# Altium schematic sheet PRR132D02.SchDoc: Плата PRR132D (continued)
## Parts (continued)
C99  C0402-16В-0,1мкФ-10%-X7R (CCTC, TCC0402X7R104K160AT)  [C0402]  (value not drawn)
C100  не устанавливать  [TAJ-A]  (value not drawn)
C101  не устанавливать  [C1210]  (value not drawn)
C102  не устанавливать  [CC1206-KL]  (value not drawn)
C103  не устанавливать  [CC1206-KL]  (value not drawn)
C104  C0603-10В-10мкф-10%-X5R (Samsung, CL10A106KP8NNNC)  [CC0603-KL]  (value not drawn)
C105  C0402-16В-0,1мкФ-10%-X7R (CCTC, TCC0402X7R104K160AT)  [C0402]  (value not drawn)
C106  C0402-16В-0,1мкФ-10%-X7R (CCTC, TCC0402X7R104K160AT)  [C0402]  (value not drawn)
C107  C0402-50В-100пФ-5%-NPO (Walsin, 0402N101J500CT)  [C0402]  (value not drawn)
C108  C0402-50В-100пФ-5%-NPO (Walsin, 0402N101J500CT)  [C0402]  (value not drawn)
C109  C0402-10В-1мкФ-10%-X5R (CCTC, TCC0402X5R105K100AT)  [C0402]  (value not drawn)
C110  C0402-10В-1мкФ-10%-X5R (CCTC, TCC0402X5R105K100AT)  [C0402]  (value not drawn)
C111  C0402-50В-0,01мкФ-10%-X7R (Samsung, CL05B103KB5NNNC)  [C0402]  (value not drawn)
CP1  *  [COMMON_POINT _1.0]  (value not drawn)  (net tie, no BOM)
DA1  TLV1117LV33DCYR (TI, SOT-223)  [SOT-223]  (value not drawn)
DA2  TLV1117LV33DCYR (TI, SOT-223)  [SOT-223]  (value not drawn)
DA4  TPS73125DBVR (SOT-23-5, TI)  [SOT23-5]  (value not drawn)
DA5  TL431BQDBZR (TI, SOT23-3)  [SOT-23A]  (value not drawn)
DA6  MCP1700T-3302E/TT (Mic,SOT23-3)  [SOT-23A]  (value not drawn)
DD7  SN74LVC1G17DBV (Ti,SOT23-5)  [SOT23-5]  (value not drawn)
DD8  MC74ACT125DTR2 (OnSemi, TSSOP-14)  [TSOP-14(0.65)]  (value not drawn)
DD9  MC74ACT125DTR2 (OnSemi, TSSOP-14)  [TSOP-14(0.65)]  (value not drawn)
DD10  RTL8201FRI-VD-CG  [QFN-24(0.5)-PAD]
DD11  NL27WZ17DFT2G (ONSemi, SC70-6)  [SOT65P210-6N]  (value not drawn)
DD12  NL27WZ17DFT2G (ONSemi, SC70-6)  [SOT65P210-6N]  (value not drawn)
DD13  STM32F407VET6 (STM, LQFP-100)  [TSQFP50P1600X1600X160-100N]  (value not drawn)
DD14  SN74LVC1G80DBVR (TI, SOT23-5)  [SOT23-5]  (value not drawn)
DD15  NL27WZ17DFT2G (ONSemi, SC70-6)  [SOT65P210-6N]  (value not drawn)
DD17  MB85RS16NPNF (Fujitsu, SOP-8)  [SOIC127P600X150-8N]  (value not drawn)
DD18  MX25L3233FM2I-08G (Macronix, SO-8)  [SOP127P790X216-8N]  (value not drawn)
DD20  SN74AHC1G14DCKR (TI, SC-70-5)  [SC70-5]  (value not drawn)
DD21  SN74AHC1G08DCKR (TI, SC-70-5)  [SC70_5L]  (value not drawn)
DD22  74AHCT1G125SE (Diodes, SOT-353)  [SOT65P210-5N]  (value not drawn)
DD23  74AHCT1G125SE (Diodes, SOT-353)  [SOT65P210-5N]  (value not drawn)
GQ1  DSK321STDAKAV-32,768kHz +/-5ppm (KDS, 3.2x2.5x0.9mm)  [DSK321STD]  (value not drawn)
GQ2  не устанавливать  [XTALCC320X150X90-4N]  (value not drawn)
HL35  FYLS-0603PGC (Foryard)  [KPT-1608]  (value not drawn)
HL36  FYLS-0603PGC (Foryard)  [KPT-1608]  (value not drawn)
HL37  FYLS-0603PGC (Foryard)  [KPT-1608]  (value not drawn)
HL38  FYLS-0603PGC (Foryard)  [KPT-1608]  (value not drawn)
HL39  KPT-1608SRC  [KPT-1608]  (value not drawn)
HL40  KPT-1608SRC  [KPT-1608]  (value not drawn)
HL41  не устанавливать  [KPT-1608]  (value not drawn)
HL42  не устанавливать  [KPT-1608]  (value not drawn)
L2  FB0805-5А-120 Ом (100МГц)-25%-0,02 Ом (INPAQ, MHC2012S121UBP)  [L0805]  (value not drawn)
L3  FB0805-5А-120 Ом (100МГц)-25%-0,02 Ом (INPAQ, MHC2012S121UBP)  [L0805]  (value not drawn)
L4  FB0805-5А-120 Ом (100МГц)-25%-0,02 Ом (INPAQ, MHC2012S121UBP)  [L0805]  (value not drawn)
L5  FB0805-5А-120 Ом (100МГц)-25%-0,02 Ом (INPAQ, MHC2012S121UBP)  [L0805]  (value not drawn)
L6  FB0805-5А-120 Ом (100МГц)-25%-0,02 Ом (INPAQ, MHC2012S121UBP)  [L0805]  (value not drawn)
L8  FB0805-5А-120 Ом (100МГц)-25%-0,02 Ом (INPAQ, MHC2012S121UBP)  [L0805]  (value not drawn)
L9  FB0805-5А-120 Ом (100МГц)-25%-0,02 Ом (INPAQ, MHC2012S121UBP)  [L0805]  (value not drawn)
MH1  *  [MOTB14]  (value not drawn)  (no BOM)
MH2  *  [MOTB14]  (value not drawn)  (no BOM)
MH3  *  [MOTB14]  (value not drawn)  (no BOM)
MH4  *  [MOTB14]  (value not drawn)  (no BOM)
MH5  *  [MOTB14]  (value not drawn)  (no BOM)
MH6  *  [MOTB14]  (value not drawn)  (no BOM)
R3  RC02-47кОм 1%  [R0402]  (value not drawn)
R4  RC02-47кОм 1%  [R0402]  (value not drawn)
R5  RC02-47кОм 1%  [R0402]  (value not drawn)
R6  RC02-47кОм 1%  [R0402]  (value not drawn)
R7  RC02-1,5кОм 5%  [R0402]  (value not drawn)
R8  RC02-1,0кОм 1%  [R0402]  (value not drawn)
R59  RC02-47кОм 1%  [R0402]  (value not drawn)
R60  Не устанавливать  [R0402]  (value not drawn)
R61  RC02-4,7кОм 5%  [R0402]  (value not drawn)
R62  RC02-10кОм 1%  [R0402]  (value not drawn)
R63  RC02-100 Ом 1% (Viking, CR-02FL6--100R)  [R0402]  (value not drawn)
R64  RC02-100 Ом 1% (Viking, CR-02FL6--100R)  [R0402]  (value not drawn)
R65  RC02-22 Ом-1%  [R0402]  (value not drawn)
R66  Не устанавливать  [R0402]  (value not drawn)
R67  Не устанавливать  [R0402]  (value not drawn)
R68  Не устанавливать  [R0402]  (value not drawn)
R69  RC02-22 Ом-1%  [R0402]  (value not drawn)
R70  RC02-22 Ом-1%  [R0402]  (value not drawn)
R71  RC02-22 Ом-1%  [R0402]  (value not drawn)
R72  RC02-22 Ом-1%  [R0402]  (value not drawn)
R73  Не устанавливать  [R0402]  (value not drawn)
R74  Не устанавливать  [R0402]  (value not drawn)
R75  Не устанавливать  [R0402]  (value not drawn)
R76  Не устанавливать  [R0402]  (value not drawn)
R77  RC03-0,0 Ом 5%  [RC0603-KL]  (value not drawn)
R78  Не устанавливать  [RC0603-KL]  (value not drawn)
R79  RC02-10кОм 1%  [R0402]  (value not drawn)
R80  RC03-0,0 Ом 5%  [RC0603-KL]  (value not drawn)
R81  не устанавливать  [RC0603-KL]  (value not drawn)
R82  RC02-10кОм 1%  [R0402]  (value not drawn)
R83  RC03-0,0 Ом 5%  [RC0603-KL]  (value not drawn)
R84  не устанавливать  [RC0603-KL]  (value not drawn)
R85  RC02-4,7кОм 5%  [R0402]  (value not drawn)
R86  RC02-2,37кОм 1% (Walsin, WR04X2371FTL)  [R0402]  (value not drawn)
R87  RC02-4,7кОм 5%  [R0402]  (value not drawn)
R88  RC02-330 Ом 5% (Viking, CR-02JL6--330R)  [R0402]  (value not drawn)
R89  RC02-330 Ом 5% (Viking, CR-02JL6--330R)  [R0402]  (value not drawn)
R90  RC02-330 Ом 5% (Viking, CR-02JL6--330R)  [R0402]  (value not drawn)
R91  RC02-330 Ом 5% (Viking, CR-02JL6--330R)  [R0402]  (value not drawn)
R92  RC02-330 Ом 5% (Viking, CR-02JL6--330R)  [R0402]  (value not drawn)
R93  RC02-330 Ом 5% (Viking, CR-02JL6--330R)  [R0402]  (value not drawn)
R94  RC02-22 Ом-1%  [R0402]  (value not drawn)
R95  RC02-10кОм 1%  [R0402]  (value not drawn)
R96  RC03-0,0 Ом 5%  [RC0603-KL]  (value not drawn)
R97  RC03-20МОм 5%  [RC0603-KL]  (value not drawn)
R98  RC02-3,01кОм 1%  [R0402]  (value not drawn)
R99  RC02-22 Ом-1%  [R0402]  (value not drawn)
R100  RC02-22 Ом-1%  [R0402]  (value not drawn)
R101  RC02-10кОм 1%  [R0402]  (value not drawn)
R102  RC02-0,0 Ом 5%  [R0402]  (value not drawn)
R103  RC03-180 Ом 1%  [RC0603-KL]  (value not drawn)
R104  RC02-22 Ом-1%  [R0402]  (value not drawn)
R105  RC02-22 Ом-1%  [R0402]  (value not drawn)
R106  RC02-22 Ом-1%  [R0402]  (value not drawn)
R107  RC02-22 Ом-1%  [R0402]  (value not drawn)
R108  RC02-22 Ом-1%  [R0402]  (value not drawn)
R109  RC02-22 Ом-1%  [R0402]  (value not drawn)
R110  RC02-22 Ом-1%  [R0402]  (value not drawn)
R111  RC02-0,0 Ом 5%  [R0402]  (value not drawn)
R112  RC02-22 Ом-1%  [R0402]  (value not drawn)
R113  RC02-22 Ом-1%  [R0402]  (value not drawn)
R114  RC02-22 Ом-1%  [R0402]  (value not drawn)
R115  RC02-22 Ом-1%  [R0402]  (value not drawn)
R116  RC02-22 Ом-1%  [R0402]  (value not drawn)
R117  RC02-22 Ом-1%  [R0402]  (value not drawn)
R118  RC02-22 Ом-1%  [R0402]  (value not drawn)
R119  RC02-22 Ом-1%  [R0402]  (value not drawn)
R120  RC02-1,0кОм 1%  [R0402]  (value not drawn)
R121  Не устанавливать  [R0402]  (value not drawn)
R122  RC02-4,7кОм 5%  [R0402]  (value not drawn)
R123  Не устанавливать  [R0402]  (value not drawn)
R124  RC02-4,7кОм 5%  [R0402]  (value not drawn)
R125  RC02-4,7кОм 5%  [R0402]  (value not drawn)
R128  RC02-4,7кОм 5%  [R0402]  (value not drawn)
R129  RC03-2,49кОм 1% (Yageo, RC0603FR-072K49L)  [RC0603-KL]  (value not drawn)
R130  RC02-1,5кОм 5%  [R0402]  (value not drawn)
R131  RC02-10кОм 1%  [R0402]  (value not drawn)
R133  RC02-22 Ом-1%  [R0402]  (value not drawn)
R134  RC02-22 Ом-1%  [R0402]  (value not drawn)
R135  RC02-10кОм 1%  [R0402]  (value not drawn)
R137  RC02-1,5кОм 5%  [R0402]  (value not drawn)
R138  RC02-1,5кОм 5%  [R0402]  (value not drawn)
R139  RC02-49,9 Ом 1%  [R0402]  (value not drawn)
R140  RC02-49,9 Ом 1%  [R0402]  (value not drawn)
R141  RC02-49,9 Ом 1%  [R0402]  (value not drawn)
R142  RC02-49,9 Ом 1%  [R0402]  (value not drawn)
R143  RC02-1,0кОм 1%  [R0402]  (value not drawn)
R144  RC02-47кОм 1%  [R0402]  (value not drawn)
R147  RC02-4,7кОм 5%  [R0402]  (value not drawn)
R148  RC02-4,7кОм 5%  [R0402]  (value not drawn)
R149  RC02-470 Ом 1%  [R0402]  (value not drawn)
R150  RC02-470 Ом 1%  [R0402]  (value not drawn)
R152  RC02-3,01кОм 1%  [R0402]  (value not drawn)
R153  RC02-3,01кОм 1%  [R0402]  (value not drawn)
R154  RC02-3,01кОм 1%  [R0402]  (value not drawn)
R155  RC02-330 Ом 5% (Viking, CR-02JL6--330R)  [R0402]  (value not drawn)
R156  RC02-330 Ом 5% (Viking, CR-02JL6--330R)  [R0402]  (value not drawn)
R157  RC05-1,0МОм 5%  [RC0805-KL]  (value not drawn)
R158  RC02-1,5кОм 5%  [R0402]  (value not drawn)
R160  Не устанавливать  [R0402]  (value not drawn)
R161  Не устанавливать  [R0402]  (value not drawn)
R162  RC03-10МОм 5%  [RC0603-KL]  (value not drawn)
R163  RC03-20МОм 5%  [RC0603-KL]  (value not drawn)
R164  RC02-47кОм 1%  [R0402]  (value not drawn)
R165  RC02-47кОм 1%  [R0402]  (value not drawn)
R166  RC02-1,5кОм 5%  [R0402]  (value not drawn)
R167  RC02-0,0 Ом 5%  [R0402]  (value not drawn)
R168  RC02-0,0 Ом 5%  [R0402]  (value not drawn)
R169  RC02-22 Ом-1%  [R0402]  (value not drawn)
R170  RC02-22 Ом-1%  [R0402]  (value not drawn)
R173  RC03-0,0 Ом 5%  [RC0603-KL]  (value not drawn)
R174  Не устанавливать  [RC0603-KL]  (value not drawn)
SA1  DS1040-01RN (Connfly)  [SWD1-1]  (value not drawn)
SB1  C8310-AABBR000R (HSM)  [KAN0641-0431B]  (value not drawn)
T98  *  [TR15x25]  (value not drawn)  (no BOM)
VD6  MBR0520L (ONSemi, SOD-123)  [SOD123]  (value not drawn)
VD7  MBR0520L (ONSemi, SOD-123)  [SOD123]  (value not drawn)
VD8  MBR0520L (ONSemi, SOD-123)  [SOD123]  (value not drawn)
VD9  BZV55C5V1 (Phil,SOD80C)  [DL-35]  (value not drawn)
VD10  BZV55C5V1 (Phil,SOD80C)  [DL-35]  (value not drawn)
VD12  NUP4114HMR6T1G (OnSemi, SOT23-6)  [SOT23-6]  (value not drawn)
VD13  BAW156 (NXP, SOT-23)  [SOT-23A]  (value not drawn)
VD14  BAW156 (NXP, SOT-23)  [SOT-23A]  (value not drawn)
VT3  IRLML6401 (Infineon, SOT-23)  [SOT-23A]  (value not drawn)
VT4  BC817-40L (ONSemi, SOT-23)  [SOT-23A]  (value not drawn)
VT5  BC857B (NXP, SOT-23)  [SOT-23A]  (value not drawn)
X1  Battery holder DS1092-07-W8L (Connfly)  [CR2032_DIP_Batt]  (value not drawn)
XP1  BH2-08  [BH2S-08 (AMTEK)]  (value not drawn)  (parts A,B,C,D,E,F,G,H of 8)
XP2  PLS-1 (Connfly, DS1021-1*40SF11) 2 шт  [JUMP2]  (value not drawn)
XS2  PBD2-2-7SM (HSM, C6802-14BDGLYQR)  [PBD2-14SM]  (value not drawn)  (parts A,B,C,D,E,F,G,H,I,J,K,L,M,N of 14)
XS3  PBD2-2-13SM-G-PCG-4,6mm  [PBD2-26SM]  (value not drawn)  (parts A,B,C,D,E,F,G,H,I,J,K,L,M,N,O,P,Q,R,S,T,U,V,W,X,Y,Z of 26)
XS4  PBD2-2-13SM-G-PCG-4,6mm  [PBD2-26SM]  (value not drawn)  (parts A,B,C,D,E,F,G,H,I,J,K,L,M,N,O,P,Q,R,S,T,U,V,W,X,Y,Z of 26)
XS5  PBD2-2-4SM (HSM, C6802-08BDGLYQR)  [PBD2-8SM]  (value not drawn)
XS6  PBD2-2-4SM (HSM, C6802-08BDGLYQR)  [PBD2-8SM]  (value not drawn)
XS7  C8362-05BBSBR1R  (Hsuan Mao)  [Micro_USB_B_TH_V]  (value not drawn)
XS8  PBD2-2-7SM (HSM, C6802-14BDGLYQR)  [PBD2-14SM]  (value not drawn)  (parts A,B,C,D,E,F,G,H,I,J,K,L,M,N of 14)

## Nets
3.3_485: C110.2 DA6.2(Vout) MH5.1 XS5.3 XS6.2
3.3V: C23.1 C58.1 C76.2 DD15.5(VCC) HL36.A HL37.A L5.2 L6.1 MH3.1 R59.1 R62.2 R80.1 R83.1 R98.2 R122.1 R123.1 R124.1 R128.1 R130.1 R131.1 R147.2 R148.2 R149.1 R150.1 R160.1 R161.1 VT3.3(D) XS4.16
3.3V_ETH: C68.1 C71.2 C74.1 C80.1 C81.2 DD10.10(DVDDIO) L6.2 R139.2 R140.2 R141.2 R142.2 XS8.11 XS8.12
3.3V_SYS: BQ2.1(OE) C14.2 C34.2 C35.2 C38.2 C41.2 C44.2 C47.2 C49.2 C51.2 C53.2 C54.2 C63.2 C65.2 C66.2 DA2.2(OUT) DD13.11(VDD) DD13.19(VDD) DD13.28(VDD) DD13.50(VDD) DD13.75(VDD) DD13.100(VDD) DD14.5(VCC) DD17.8(VDD) DD18.8(VCC) DD20.5(VCC) DD21.5(VCC) HL38.A HL39.A HL40.A L3.2 L4.1 MH2.1 R60.1 R61.1 R67.1 R78.2 R101.1 R135.2 R137.1 R138.1 R144.2 R158.2 R164.2 R165.2 R166.1 VD13.3 XP1.1 XP2.1 XS3.26
5V: C11.2 C13.1 C21.2 C22.2 C30.1 C105.1 C106.1 C109.2 DA1.3(IN) DA6.3(Vin) DD8.14(VCC) DD9.14(VCC) DD22.5(VCC) DD23.5(VCC) L2.2 MH1.1 R81.1 R84.1 VD6.1(A) XS4.13 XS4.14 XS5.1 XS5.2 XS6.1
GND: BQ2.2(GND) C10.1 C11.1 C12.2 C13.2 C14.1 C15.2 C16.2 C17.2 C18.2 C19.2 C20.2 C21.1 C22.1 C24.1 C25.1 C26.1 C27.1 C28.1 C29.2 C30.2 C31.2 C32.1 C33.1 C34.1 C35.1 C36.1 C37.1 C38.1 C39.2 C41.1 C42.1 C44.1 C45.1 C47.1 C49.1 C51.1 C53.1 C54.1 C55.2 C56.2 C57.2 C58.2 C59.2 C60.2 C61.2 C62.2 C63.1 C64.2 C65.1 C66.1 C67.1 C68.2 C69.1 C70.1 C71.1 C73.2 C74.2 C76.1 C80.2 C81.1 C83.2 C85.1 C86.2 C87.1 C88.2 C89.1 C90.2 C97.1 C99.1 C100.2 C101.2 C102.2 C103.2 C105.2 C106.2 C107.2 C108.2 C109.1 C110.1 C111.1 CP1.1 DA6.1(GND) DD7.3(GND) DD8.1(~{OE1}) DD8.4(~{OE2}) DD8.7(GND) DD8.10(~{OE3}) DD8.12(4A) DD8.13(~{OE4}) DD9.1(~{OE1}) DD9.4(~{OE2}) DD9.7(GND) DD9.10(~{OE3}) DD9.13(~{OE4}) DD10.23(CKXTAL1) DD10.25(ExpPAD) DD11.2(GND) DD12.2(GND) DD13.10(VSS) DD13.27(VSS) DD13.74(VSS) DD13.99(VSS) DD14.3(GND) DD15.2(GND) DD15.3(A2) DD17.4(VSS) DD18.4(VSS) DD20.3(GND) DD21.3(GND) DD22.1(~{OE}) DD22.3(GND) DD23.1(~{OE}) DD23.3(GND) GQ1.2(GND) GQ2.2(GND) HL35.C L9.1 MH4.1 R3.2 R4.2 R5.2 R6.2 R66.2 R68.1 R73.2 R74.2 R75.2 R76.2 R77.1 R85.1 R87.2 R95.1 R121.2 R125.2 R129.1 R157.1 R162.2 R173.1 SA1.2 SB1.1 VD9.1(A) VD10.1(A) VD12.2 VT4.2(E) X1.2 XP1.8 XS2.1 XS2.2 XS2.11 XS2.13 XS3.3 XS3.4 XS3.9 XS3.10 XS3.15 XS3.16 XS3.21 XS3.22 XS4.3 XS4.5 XS4.7 XS4.9 XS4.15 XS5.7 XS5.8 XS6.7 XS6.8 XS8.3 XS8.5 XS8.7 XS8.9
GNDA: C40.1 C43.1 C46.1 C48.2 C50.1 C52.1 C91.2 C92.2 C93.2 C94.2 C95.2 C96.2 C104.1 CP1.2 DA4.2(GND) DA5.3(AN) DD13.20(VSSA) R103.1 XS4.17 XS4.18 XS4.25 XS4.26
USB_V: C89.2 L8.1 R7.1 VD7.1(A) VD12.5
3,3V_EN: DD13.7(PC13) MH6.1 R79.1 R82.2
25MHz_CPU: DD13.12(PH0/OSC_IN) R110.2
32k: BQ1.1 C29.1 DD13.8(PC14) GQ1.3(OUT) GQ2.3(OUT) R97.2
ADC IN1: R93.2 XS4.21
ADC IN2: R91.2 XS4.20
ADC IN3: R92.2 XS4.19
ADC IN4: R89.2 XS4.24
ADC IN5: R88.2 XS4.23
ADC IN6: R90.2 XS4.22
AI1: C94.1 DD13.18(PC3) R93.1
AI2: C91.1 DD13.36(PB1) R91.1
AI3: C95.1 DD13.17(PC2) R92.1
AI4: C92.1 DD13.26(PA3) R89.1
AI5: C96.1 DD13.23(PA0) R88.1
AI6: C93.1 DD13.35(PB0) R90.1
AO_OK1: C107.1 DD13.79(PC11) R169.2
AO_OK2: C108.1 DD13.78(PC10) R170.2
AVAR: DD13.69(PA10) R143.2
BOOT0: DD13.94(BOOT0) DD20.2(A) R8.2 R95.2
CH485_2: DD13.39(PE8) R62.1 XS6.4
CH_OUT1: DD13.98(PE1) R59.2 XS3.18
CONTR_IN: DD8.6(2Y) XS4.10
CONTR_OUT: DD23.4(Y) XS3.12
CS_PRM1: DD13.60(PD13)
CS_PRM2: DD13.46(PE15)
CTR_IN: DD8.5(2A) DD13.42(PE11)
CTR_OUT: DD13.82(PD1) DD23.2(A)
DI1: R104.1 XS2.10
DI2: R105.1 XS2.8
DI3: R106.1 XS2.14
DI4: R107.1 XS2.12
DI5: R108.1 XS2.7
DI6: R109.1 XS2.9
DIF1: C59.1 DD13.44(PE13) R104.2
DIF2: C55.1 DD13.58(PD11) R105.2
DIF3: C60.1 DD21.1(A) R106.2
DIF4: C56.1 DD13.41(PE10) R107.2
DIF5: C61.1 DD13.57(PD10) R108.2
DIF6: C57.1 DD13.65(PC8) R109.2
DIL_EN: DD13.84(PD3)
DS1: R69.2 XS2.3
DS2: R70.2 XS2.5
DS3: R71.2 XS2.4
DS4: R72.2 XS2.6
DS_B1: DD11.6(Y1) DD13.63(PC6)
DS_B2: DD11.4(Y2) DD13.64(PC7)
DS_B3: DD12.6(Y1) DD13.67(PA8)
DS_B4: DD12.4(Y2) DD13.68(PA9) DD13.95(PB8)
ETH_CRS_DV: DD13.32(PA7) R117.1
ETH_MDC: DD13.16(PC1) R118.1
ETH_MDIO: DD13.25(PA2) R119.1
ETH_REF_CLK: DD13.24(PA1) R102.2
ETH_RES: C62.1 DD10.15(PHYRSTB) R120.2 R131.2
ETH_RX_N: C83.1 DD10.6(MDI-[1]) R142.1 XS8.4
ETH_RX_P: C86.1 DD10.5(MDI+[1]) R141.1 XS8.6
ETH_RXD0: DD13.33(PC4) R115.1
ETH_RXD1: DD13.34(PC5) R116.1
ETH_TX_EN: DD13.48(PB11) R114.1
ETH_TX_N: C88.1 DD10.4(MDI-[0]) R140.1 XS8.8
ETH_TX_P: C90.1 DD10.3(MDI+[0]) R139.1 XS8.10
ETH_TXD0: DD13.51(PB12) R112.1
ETH_TXD1: DD13.52(PB13) R113.1
F1: DD13.1(PE2) R153.1
F2: DD13.93(PB7) R152.1
JB0: R8.1 XP2.2 XS3.25
LATCH_IN: DD8.3(1Y) XS4.8
LATCH_OUT: DD22.4(Y) XS3.11
LCH_IN: DD8.2(1A) DD13.43(PE12) R5.1
LCH_OUT: DD13.83(PD2) DD22.2(A) R6.1
LED_link: DD10.19(LED1) HL41.C R148.1 XS8.14
LED_speed: DD10.18(LED0/PMEB/INTB) HL42.C R147.1 XS8.13
P_OK: C27.2 DD13.61(PD14) R86.1 R87.1
P_OK_IN: R86.2 XS3.17
PWM_AO1: DD13.92(PB6) XS3.13
PWM_AO2: DD13.62(PD15) XS3.14
RES_DEF: C64.1 DD13.2(PE3) R135.1 SB1.2
RESET: DD13.3(PE4) R120.1
RUN_ST: C85.2 DD13.5(PE6) R158.1 SA1.1
S1_CS_FLASH: DD13.96(PB9) DD18.1(CS#) R165.1
S1_CS_FRAM: DD13.29(PA4) DD17.1(~{CS}) R164.1
S1_MISO: DD13.31(PA6) DD17.2(SO) DD18.2(SO)
S1_MOSI: DD13.91(PB5) DD17.5(SI) DD18.5(SI) R61.2
S1_SCK: DD13.30(PA5) DD17.6(SCK) DD18.6(SCLK)
S2_MISO: DD13.53(PB14)
S2_MOSI: DD13.54(PB15) R67.2
S2_SCK: DD13.47(PB10)
S3_CS: DD9.9(3A) DD13.77(PA15)
S3_MISO: DD7.4(Y) DD13.90(PB4)
S3_MOSI: DD9.2(1A) DD13.80(PC12) R60.2
S3_SCK: DD9.5(2A) DD13.89(PB3)
SPI3_CS: DD9.8(3Y) XS4.4
SPI3_MISO: R65.2 XS3.7 XS4.12
SPI3_MOSI: DD9.3(1Y) XS3.8 XS4.1
SPI3_SCK: DD9.6(2Y) XS3.6 XS4.2
SV1: DD13.66(PC9) R155.2
SV2: DD13.15(PC0) R154.1
SW_V/I1: DD13.88(PD7) XS3.19
SW_V/I2: DD13.59(PD12) XS3.20
SWCLK: DD13.76(PA14) R134.2 VD9.2(K)
SWDIO: DD13.72(PA13) R133.2 VD10.2(K)
UART2_DIR: DD13.4(PE5) R3.1 XS5.5
UART2_RX: R63.1 XS5.6
UART2_TX: DD13.86(PD5) XS5.4
UART3_DIR: DD13.38(PE7) R4.1 XS6.5
UART3_RX: R64.1 XS6.3
UART3_TX: DD13.55(PD8) XS6.6
USB_D_N: DD13.70(PA11) VD12.6 XS7.2
USB_D_P: DD13.71(PA12) VD12.1 XS7.3
V_GEN: C97.2 C99.2 GQ1.1(VCC) GQ1.4(VCC) GQ2.1(OE) GQ2.4(VDD) VD13.1 VT5.3(K)
VBAT: DD13.6(VBAT) R163.1 VT5.2(E) X1.1
VREF: C46.2 C50.2 C104.2 DA4.5(OUT) DA5.2(REF) DD13.21(VREF+) R103.2 R167.1
WR_IN: DD8.9(3A) DD13.40(PE9)
WR_LED_IN: DD13.81(PD0)
WR_LED_OUT: DD13.85(PD4)
WR_OUT: DD9.12(4A) DD13.45(PE14)
WRITE_IN: DD8.8(3Y) XS4.6
WRITE_OUT: DD9.11(4Y) XS3.5
NetBQ1_2: BQ1.2 C31.1 R96.2
NetBQ2_3: BQ2.3(OUT) R99.1 R100.1
NetBQ2_4: BQ2.4(VCC) C36.2 L3.1
NetC10_2: C10.2 DD13.87(PD6) R63.2
NetC12_1: C12.1 DD13.56(PD9) R64.2
NetC15_1: C15.1 DD7.2(A) R65.1 R66.1
NetC16_1: C16.1 DD11.1(A1) R69.1 R73.1
NetC17_1: C17.1 DD12.1(A1) R71.1 R75.1
NetC18_1: C18.1 DD11.3(A2) R70.1 R74.1
NetC19_1: C19.1 DD12.3(A2) R72.1 R76.1
NetC20_1: C20.1 DD7.5(VCC) R80.2 R81.2
NetC23_2: C23.2 R82.1 VT3.1(G)
NetC24_2: C24.2 C25.2 DD11.5(VCC) DD12.5(VCC) R83.2 R84.2
NetC26_2: C26.2 DD10.11(REF_CLK) R111.2
NetC28_2: C28.2 VD6.2(C) VD8.1(A)
NetC32_2: C32.2 DA2.3(IN) VD7.2(C) VD8.2(C)
NetC33_2: C33.2 DD10.2(AVDD10OUT)
NetC37_2: C37.2 C111.2 DA1.2(OUT) R79.2 R174.2 VT3.2(S)
NetC39_1: C39.1 DD13.14(NRST) R101.2
NetC40_2: C40.2 C43.2 C48.1 DA4.1(IN) DA4.3(ON) DD13.22(VDDA) L4.2 R168.2
NetC42_2: C42.2 DD13.49(VCAP_1)
NetC45_2: C45.2 DD13.73(VCAP_2)
NetC52_2: C52.2 DA4.4(NC) DA5.1(CAT) R167.2 R168.1
NetC67_2: C67.2 C70.2 C73.1 DD10.7(AVDD33) L5.1
NetC69_2: C69.2 DD10.22(DVDD10OUT)
NetC87_2: C87.2 R157.2 XS7.6
NetC100_1: C100.1 C101.1 C102.1 C103.1 DD17.7(~{HOLD}) R166.2
NetDA1_1: DA1.1(GND) R173.2 R174.1
NetDA2_1: DA2.1(GND) R77.2 R78.1
NetDD10_1: DD10.1(RSET) R129.2
NetDD10_8: DD10.8(RXD[0]/CLK_CTL) R115.2 R121.1 R122.2
NetDD10_9: DD10.9(RXD[1]) R116.2 R123.2 R125.1
NetDD10_12: DD10.12(TXD[0]) R112.2
NetDD10_13: DD10.13(TXD[1]) R113.2
NetDD10_14: DD10.14(TXEN) R114.2
NetDD10_16: DD10.16(MDC) R118.2
NetDD10_17: DD10.17(MDIO) R119.2 R130.2
NetDD10_20: DD10.20(CRS_DV/PHYAD[0]) R85.2 R117.2 R128.2
NetDD10_21: DD10.21(RXER/IO_V_SEL) R124.2
NetDD10_24: DD10.24(CKXTAL2) R94.2
NetDD13_9: DD13.9(PC15) R96.1 R97.1
NetDD13_13: DD13.13(PH1/OSC_OUT) R68.2
NetDD13_37: DD13.37(PB2) DD21.4(Y)
NetDD13_97: DD13.97(PE0) R7.2
NetDD14_1: DD14.1(D) DD14.4(~{Q}) R110.1
NetDD14_2: DD14.2(C) R100.2
NetDD15_1: DD15.1(A1) R99.2
NetDD15_6: DD15.6(Y1) R94.1 R102.1 R111.1
NetDD17_3: DD17.3(~{WP}) R137.2
NetDD18_3: DD18.3(WP#) DD18.7(HOLD#) R138.2
NetDD20_4: DD20.4(Y) DD21.2(B)
NetHL35_A: HL35.A R98.1
NetHL36_C: HL36.C R152.2
NetHL37_C: HL37.C R153.2
NetHL38_C: HL38.C R154.2
NetHL39_C: HL39.C R155.1
NetHL40_C: HL40.C R156.2
NetHL41_A: HL41.A R160.2
NetHL42_A: HL42.A R161.2
NetL2_1: L2.1 XS3.1 XS3.2
NetL8_2: L8.2 XS7.1
NetL9_2: L9.2 XS7.5
NetR133_1: R133.1 XP1.5
NetR134_1: R134.1 XP1.6
NetR143_1: R143.1 R144.1 VT4.1(B)
NetR149_2: R149.2 XS8.2
NetR150_2: R150.2 XS8.1
NetR156_1: R156.1 VT4.3(K)
NetR162_1: R162.1 VD13.2 VD14.1
NetR163_2: R163.2 VD14.3 VT5.1(B)
NetR169_1: R169.1 XS3.23
NetR170_1: R170.1 XS3.24
NetT98_1: T98.1 XS4.11

Not connected (* = marked no-connect by the designer): DD7 1(NC)*; DD8 11(4Y)*; DD15 4(Y2)*; DD20 1(NC)*; VD12 3* 4*; VD14 2*; XP1 2* 3* 4* 7*; XS5 MH1 MH2; XS6 MH1 MH2; XS7 4*

## Layout directives
differential pair: ETH_RX_N, ETH_RX_P, ETH_TX_N, ETH_TX_P, USB_D_N, USB_D_P

## Notes on the sheet
- Питание и дискретные выходы
- (near DD13) ADC123_0
- (near DD13) GPO
- (near XP1) 1
- (near XP1) 2
- VCC
- NRST
- +5V
- На нижнюю плату
- (near MH1) "5V"
- (near DD13) ETH_REF_CLK
- (near DD13) ETH_MDIO
- (near DD13) ADC123_1
- (near XP1) 3
- (near XP1) 4
- (near XP1) 5
- TDI
- TDO
- TMS/SWDIO
- USB
- GND
- "GND"
- (near DD13) SPI1/3_NSS
- (near DD13) SPI1_SCK
- (near DD13) UA2_TX
- (near XP1) 6
- (near XP1) 7
- RESET
- TCK/SWCLK
- D-
- WR
- SPI_SCK
- (near DD9) 5V@0,08мА
- (near DD13) SPI1_MISO
- (near DD13) ETH_CRS_DV
- (near DD13) T1_1
- (near DD13) UA2_RX
- (near DD13) UA3_TX
- (near XP1) 8
- D+
- NC
- SPI_MISO
- SPI_MOSI
- (near DD13) T1_2
- (near DD13) UA3_RX
- (near DD13) GPI
- LATCH
- (near DD13) OTG_FS_DM
- (near DD13) OTG_FS_DP
- (near DD13) SWDIO
- (near DD13) T4_1
- CONTR
- PWM_AO1
- Сигналы, выделенные зеленым цветом, можно менять между собой
- (near DD13) SWCLK
- (near DD13) T4_4
- "F2"
- 3.3V@1,2мА
- PWM_AO2
- (near DD13) ADC12_8
- (near DD13) ADC12_9
- "F1"
- POWER_OK
- CH1
- (near DD13) SPI1/3_SCK
- (near DD13) SPI1/3_MISO
- (near DD13) BOOT1
- "M1"
- 3.3V@4мА
- SW_V/I1
- SW_V/I2
- (near DD13) SPI1/3_MOSI
- Три варианта конденсаторов для случая, если вместо FRAM будет использоваться EERAM
- (near C100) 0,1$
- (near C101) 0,15$
- 0,2$
- "M2"
- AO_OK1
- (near DD13) T10_1
- 3.3V@2,5мА
- "Авария"
- 3,3V_SYS
- BOOT0
- AO_OK2
- (near DD13) ETH_TX_EN
- (near DD13) SPI2_SCK
- (near R158) 3.3V@0,4мА
- RS485_1
- Поближе к микроконтроллеру
- (near DD13) ETH_TXD0
- (near DD13) ETH_TXD1
- (near DD13) SPI2_MISO
- 5V
- (near XS5) 5V@100mA
- (near DD13) SPI2_MOSI
- RS485_TX1
- RS485_RTS1
- 3,3V
- (near DD13) ADC123_12
- (near DD13) ETH_MDC
- RS485_RX1
- (near DD13) ADC123_13
- (near DD13) ETH_RXD0
- альтернатива. совместить
- (near XS5) RS485_2 (PRR12B)
- (near DD13) ETH_RXD1
- (near DD13) T8_2/T3_2
- (near DD13) T8_1
- (near XS6) 5V@100mA
- 3.3V@0.33mA
- RS485_RX2
- CHECK
- (near DD13) SPI3_MOSI
- RS485_TX2
- RS485_RTS2
- (near DD13) OSC32_IN
- (near DD13) OSC32_OUT
- (near MH5) "3,3_485"
- (near C104) SPI1, SPI2 - FRAM, FLASH
  SPI3 (TX, RX) - DI, DAT, DO, IND - DMA2.1, DMA2.2, ПРМ
  ADC - DMA1.1
  USART2 (TX) - DMA1.7
  UART4 (TX) - DMA2.5
- Конденсатор 10мкФ должен располагаться как можно ближе к 100 выводу процессора
- ETHERNET
- (near DD13) 3.3V@70мА
- (near R139) MDI signal traces should have 50 Ω to ground or 100-Ω
  differential controlled impedance
- На среднюю плату
- Дискретные входы
- (near GQ1) Альтернатива BQ1
- Альтернатива GQ1
- 3.3V_LED_S
- 3.3V_LED_L
- RD-
- TD-
- RD+
- SPI_CSD
- TD+
- 3.3V_ETH
- LED_S
- REZERV
- (near HL41) "Link"
- (near HL42) "Speed"
- LED_L
- (near DD10) 3.3V@92мА
- (near R161) 3.3V@2,4мА
- GNDA
- Дорожки выполнить минимальной длины, под дорожками расположить земляной полигон для уменьшения влияния ВЧ.
- Микросхема сильно греется, необходимо сделать полигон для теплоотвода и широкие дорожки к пинам для отвода тепла
- AI1
- AI2
- AI3
- AI5
- AI6
- AI4
- (near DA1) 0.33W
- 3.3V@192мА@0,33W
- (near VT3) 192mA@5mW
- DS3
- DS1
- "3,3V"
- DS2
- DS4
- DI5
- DI2
- DI6
- DI1
- (near R98) 3.3V@1мА
- DI4
- 3,3V@80mA@0.14W
- (near MH6) "3,3V_E"
- DI3
- (near MH2) "3,3V_SYS"
- Основные отличия исполнений
- отделяет питание USB от большой ёмкости (на 5V_USB нельзя вешать больше 10мкФ)
- (near CP1) Соединить с GNDA в одной точке возле DA
- PRR132D
- Вариант
- STM32F407VET6 (STM, LQFP-100)
- DD13
- C0603-10В-2,2мкФ
- C42, C45
- PRR132D-01
- GD32F407VET6  (GD, LQFP-100)
- не устанавливать
- Перв. примен.
- Справ. №
- Подп. дата
- Инв. № дубл.
- Взам. инв. №
- Подп. и дата
- Изм.
- Лист
- № докум.
- Подп.
- Дата
- Лит.
- Масса
- Масштаб
- Разраб.
- Пров.
- Т. контр.
- Листов
- Инв. № подл.
- Рук. проекта
- Н. контр
- Утв.
- Копировал
- Формат А1
- (in symbol 74AHCT1G125GW) B
- (in symbol 74HC125PW) BUF; Z
- (in symbol !Header) Цепь; Конт.
- (in symbol FM25L16B-G) FRAM
- (in symbol GD25Q32CS) Flash
- (in symbol Micro_USB_B_THT_Vertical) Конт.; Цепь; Shield
- (in symbol PBD2-08SM) Цепь; Конт.
- (in symbol RTL8201FRI-VD-CG) PHY
- (in symbol SN74AHC1G08DCK) &
- (in symbol SN74LVC1G80DBV) TT
- (in symbol STM32F407VxT) CPU

## Library data of the parts
*#1 *#2 = !Header: Value: *
BQ1 = NX3215SA: Value: NX3215SA-32,768kHz±10ppm(25C)/±170ppm(-40/+85C)/6
BQ2 = FXO2520: SMD Crystal Oscillator 2.5x2.0, 2.0-50.0 MHz, 3.3V; Value2: DSO221SHF; Value3: NZ2520SB; Value: FXO2520-3,3V-50,000MHz±50ppm 15pF (Fronter)
C10 C12-C27 C32-C34 C36 C38-C41 C43 C44 C46 C47 C49-C53 C55-C61 C63-C71 C74 C76 C81 C83 C85 C86 C88-C97 C99 C105-C111 = C0402: Chip Capacitor (MLCC), 0402, Umax=50V, SIZE=1.0x0.5x0.5mm, SMT
  C10 C12 C15-C19 C55-C57 C59-C61 C107 C108: Value: C0402-50В-100пФ-5%-NPO (Walsin, 0402N101J500CT)
  C13 C14 C20-C22 C24 C25 C33 C36 C38 C39 C41 C44 C47 C49 C51 C53 C58 C63 C65-C71 C74 C76 C81 C97 C99 C105 C106: Value: C0402-16В-0,1мкФ-10%-X7R (CCTC, TCC0402X7R104K160AT)
  C23 C40 C50 C52 C64: Value: C0402-50В-0,01мкФ-10%-X7R (CCTC, TCC0402X7R103K500AT)
  C26 C83 C86 C88 C90: Value: C0402-50В-10пФ-5%-NPO (Walsin, 0402N100J500CT)
  C27 C85 C91-C96: Value: C0402-50В-1000пФ-5%-NPO (CCTC, TCC0402COG102J500AT)
  C32 C34 C43 C46 C89 C109 C110: Value: C0402-10В-1мкФ-10%-X5R (CCTC, TCC0402X5R105K100AT)
  C111: Value: C0402-50В-0,01мкФ-10%-X7R (Samsung, CL05B103KB5NNNC)
C11 C35 C73 C80 C87 = C1206
  C11 C35: Value: C1206-10В-22мкФ-10%-X5R (Samsung, CL31A226KPHNNNE)
  C73 C80: Value: C1206-16В-10мкФ-10%-X7R (Samsung, CL31B106KOHNNNE)
  C87: Value: C1206-250В-4700пФ-10%-X7R (Walsin, 1206B472K251CT); ModifyDate: 08/14/2008 11:22:34
C28 C101 = C1210
  C28: Value: C1210-6,3В-100мкФ-20%-X5R (Samsung, CL32A107MQVNNNE)
  C101: Value: не устанавливать
C29 C31 C42 C45 C48 C54 C62 C104 = C0603
  C29 C31: Value: C0603-50В-8,2пФ-0,25пФ-NP0 (CCTC, TCC0603COG8R2C500CT)
  C42 C45 C62: Value: C0603-10В-2,2мкФ-10%-X7R (Samsung, CL10B225KP8NNNC
  C48 C54: Value: C0603-10В-10мкф-10%-X5R (Samsung, CL10A106KP8NNNC); Currency: *; Distributor: *; PartNumber: *; HelpURL: *; Manufacturer: *; Volume1: *; Price1: *
  C104: Value: C0603-10В-10мкф-10%-X5R (Samsung, CL10A106KP8NNNC)
C30 C37 = C0603: Chip Capacitor (MLCC), 0603, Umax=100V, SIZE=1.6x0.8x0.9mm, SMT; Value: C0603-6,3В-4,7мкФ-10%-X5R (Samsung, CL10A475KQ8NNN; Currency: *; Distributor: *; PartNumber: *; HelpURL: *; Manufacturer: *; Volume1: *; Price1: *
C100 = TANTAL-A: Value2: CET-TAJ-10В-33мкФ-10%-A (AVX, TAJA336K010RNJ); Value: не устанавливать
C102 C103 = C1206: Value2: C1206-10В-22мкФ-10%-X5R (Samsung, CL31A226KPHNNNE); Value: не устанавливать
CP1 = COMMON_POINT: Value: *
DA1 DA2 = TLV1117: Adjustable and Fixed Low-Dropout Voltage Regulator; Value: TLV1117LV33DCYR (TI, SOT-223)
DA4 = LP2981: Value: TPS73125DBVR (SOT-23-5, TI)
DA5 = TL431QDBZ: Filter: LDO; Value: TL431BQDBZR (TI, SOT23-3)
DA6 = MCP1700: Value: MCP1700T-3302E/TT (Mic,SOT23-3); ModifyDate: 07/08/2008 23:59:18
DD7 = SN74LVC1G17DBV: Value: SN74LVC1G17DBV (Ti,SOT23-5)
DD8 DD9 = 74HC125PW: Quad buffer/line driver; 3-state; Value: MC74ACT125DTR2 (OnSemi, TSSOP-14)
DD10 = RTL8201FRI-VD-CG: SINGLE-CHIP/PORT 10/100M ETHERNET / PHYCEIVER WITH AUTO MDIX; Value: RTL8201FRI-VD-CG (REALTEK, QFN-24)
DD11 DD12 DD15 = SN74LVC2G17DCK: Value: NL27WZ17DFT2G (ONSemi, SC70-6)
DD13 = STM32F407VxT: ARM-based 32-bit MCU; Value2: GD32F407VET6  (GD, LQFP-100); Value: STM32F407VET6 (STM, LQFP-100)
DD14 = SN74LVC1G80DBV: Single Positiive Edge Triggered D-Type Flip-Flop; Value: SN74LVC1G80DBVR (TI, SOT23-5)
DD17 = FM25L16B-G: 16-Kbit (2Kx8) Serial (SPI) F-RAM; Value: MB85RS16NPNF (Fujitsu, SOP-8)
DD18 = GD25Q32CS: Dual and Quad Serial Flash; Value2: MX25L4005CM2I-I2G (Macronix, SO-8); Value: MX25L3233FM2I-08G (Macronix, SO-8)
DD20 = SN74AHC1G14DCKR: Single Schmitt trigger inverter gate; Value: SN74AHC1G14DCKR (TI, SC-70-5)
DD21 = SN74AHC1G08DCK: Single 2-input Positive and Gate; Value: SN74AHC1G08DCKR (TI, SC-70-5)
DD22 DD23 = 74AHCT1G125GW: Bus buffer/line driver, 3-state; Value: 74AHCT1G125SE (Diodes, SOT-353)
GQ1 = DSK321STD: SMD Crystal Oscillator 3.2x2.5, 32.768 kHz; Value: DSK321STDAKAV-32,768kHz +/-5ppm (KDS, 3.2x2.5x0.9mm)
GQ2 = KXO-V32T: SMD Crystal Oscillator 3.2x1.5, 32.768 kHz, 3.3V; Value: не устанавливать
HL35 HL38 HL40 = KPT-1608SRC-PRV
  HL35 HL38: Value: FYLS-0603PGC (Foryard)
  HL40: Value: KPT-1608SRC
HL36 HL37 HL39 HL41 HL42 = KPT-1608ZGC
  HL36 HL37: Value: FYLS-0603PGC (Foryard)
  HL39: Value: KPT-1608SRC
  HL41 HL42: Value: не устанавливать; Value2: KPT-1608ZGC
L2-L6 L8 L9 = L0805: Value: FB0805-5А-120 Ом (100МГц)-25%-0,02 Ом (INPAQ, MHC2012S121UBP)
MH1-MH6 = MOTB14: ComponentHeight: 0; ModifyDate: 09/16/2008 15:20:55; Value: *
R3-R8 R59-R76 R79 R82 R85-R95 R98-R102 R104-R125 R128 R130 R131 R133-R135 R137-R144 R147-R150 R152-R156 R158 R160 R161 R164-R170 = R0402: Chip Resistor, 0402, Pmax=0.063W, Umax=50V, SIZE=1.0x0.5x0.3mm, SMT
  R3-R6 R59 R144 R164 R165: Value: RC02-47кОм 1%
  R7 R130 R137 R138 R158 R166: Value: RC02-1,5кОм 5%
  R8 R120 R143: Value: RC02-1,0кОм 1%
  R60 R66-R68 R73-R76 R121 R123 R160 R161: Value: Не устанавливать
  R61 R85 R87 R122 R124 R125 R128 R147 R148: Value: RC02-4,7кОм 5%
  R62 R79 R82 R95 R101 R131 R135: Value: RC02-10кОм 1%
  R63 R64: Value: RC02-100 Ом 1% (Viking, CR-02FL6--100R)
  R65 R69-R72 R94 R99 R100 R104-R110 R112-R119 R133 R134 R169 R170: Value: RC02-22 Ом-1%
  R86: Value: RC02-2,37кОм 1% (Walsin, WR04X2371FTL)
  R88-R93 R155 R156: Value: RC02-330 Ом 5% (Viking, CR-02JL6--330R)
  R98 R152-R154: Value: RC02-3,01кОм 1%
  R102 R111 R167 R168: Value: RC02-0,0 Ом 5%
  R139-R142: Value: RC02-49,9 Ом 1%
  R149 R150: Value: RC02-470 Ом 1%
R77 R78 R173 R174 = RC03: Chip Resistor, 0603, Pmax=0.100W, Umax=50V, SIZE=1.6x0.9x0.5mm, SMT; Currency: *; Distributor: *; PartNumber: *; HelpURL: *; Manufacturer: *; Volume1: *; Price1: *
  R77 R173: Value: RC03-0,0 Ом 5%
  R78 R174: Value: Не устанавливать
R80 R81 R83 R84 R96 R97 R103 R129 R162 R163 = RC03
  R80 R83 R96: Value: RC03-0,0 Ом 5%
  R81 R84: Value: не устанавливать
  R97 R163: Value: RC03-20МОм 5%
  R103: Value: RC03-180 Ом 1%
  R129: Value: RC03-2,49кОм 1% (Yageo, RC0603FR-072K49L)
  R162: Value: RC03-10МОм 5%
R157 = RC05: Value: RC05-1,0МОм 5%
SA1 = SWD1-1: Value: DS1040-01RN (Connfly)
SB1 = KAN0641-0431B: Tact Switch 6 x 6mm, H=4.3mm; Value: C8310-AABBR000R (HSM)
T98 = TR15x25: Point to soldering; Value: *
VD6-VD8 = MBR0520: Value: MBR0520L (ONSemi, SOD-123)
VD9 VD10 = BZV55C: Value: BZV55C5V1 (Phil,SOD80C)
VD12 = SRV05-4: Value: NUP4114HMR6T1G (OnSemi, SOT23-6)
VD13 VD14 = BAW56: Value: BAW156 (NXP, SOT-23)
VT3 = IRLML6302: ComponentHeight: 45; ModifyDate: 07/10/2008 11:27:21; Value: IRLML6401 (Infineon, SOT-23)
VT4 = BC817-25: ModifyDate: 07/10/2008 12:41:29; ComponentHeight: 45; Value: BC817-40L (ONSemi, SOT-23)
VT5 = BC807-25: Value: BC857B (NXP, SOT-23)
X1 = CR2032_DIP_Holder: Part Number: C0170-03JTW000R; Manufacturer: HSUAN MAO; Value: Battery holder DS1092-07-W8L (Connfly)
XP1 = BH2S-08 (AMTEK): Value: BH2-08
XP2 = JUMP1X2: ModifyDate: 07/10/2008 10:18:03; ComponentHeight: *; Value: PLS-1 (Connfly, DS1021-1*40SF11) 2 шт
XS2 XS8 = PBD2-14SM: Value: PBD2-2-7SM (HSM, C6802-14BDGLYQR)
XS3 XS4 = PBD2-26SM: Value: PBD2-2-13SM-G-PCG-4,6mm
XS5 XS6 = PBD2-08SM: Pin Socket, Straight, Female, With PEG, POS=8, ROW=2, PITCH=2.0mm, H=4.6mm, I=1.5A, U=125VAC, SMT; Value2: DS1026-07-2*4S (Connfly); Value3: C6802-08BDGLYQR (HSM); Value: PBD2-2-4SM (HSM, C6802-08BDGLYQR)
XS7 = Micro_USB_B_THT_Vertical: Micro USB Type B 5 pin Female THT Vertical; Value: C8362-05BBSBR1R  (Hsuan Mao)